# EasyEDA Pro project STM32G303的双FOC电机驱动.eprj, schematic axdr_v1.2 (continued)
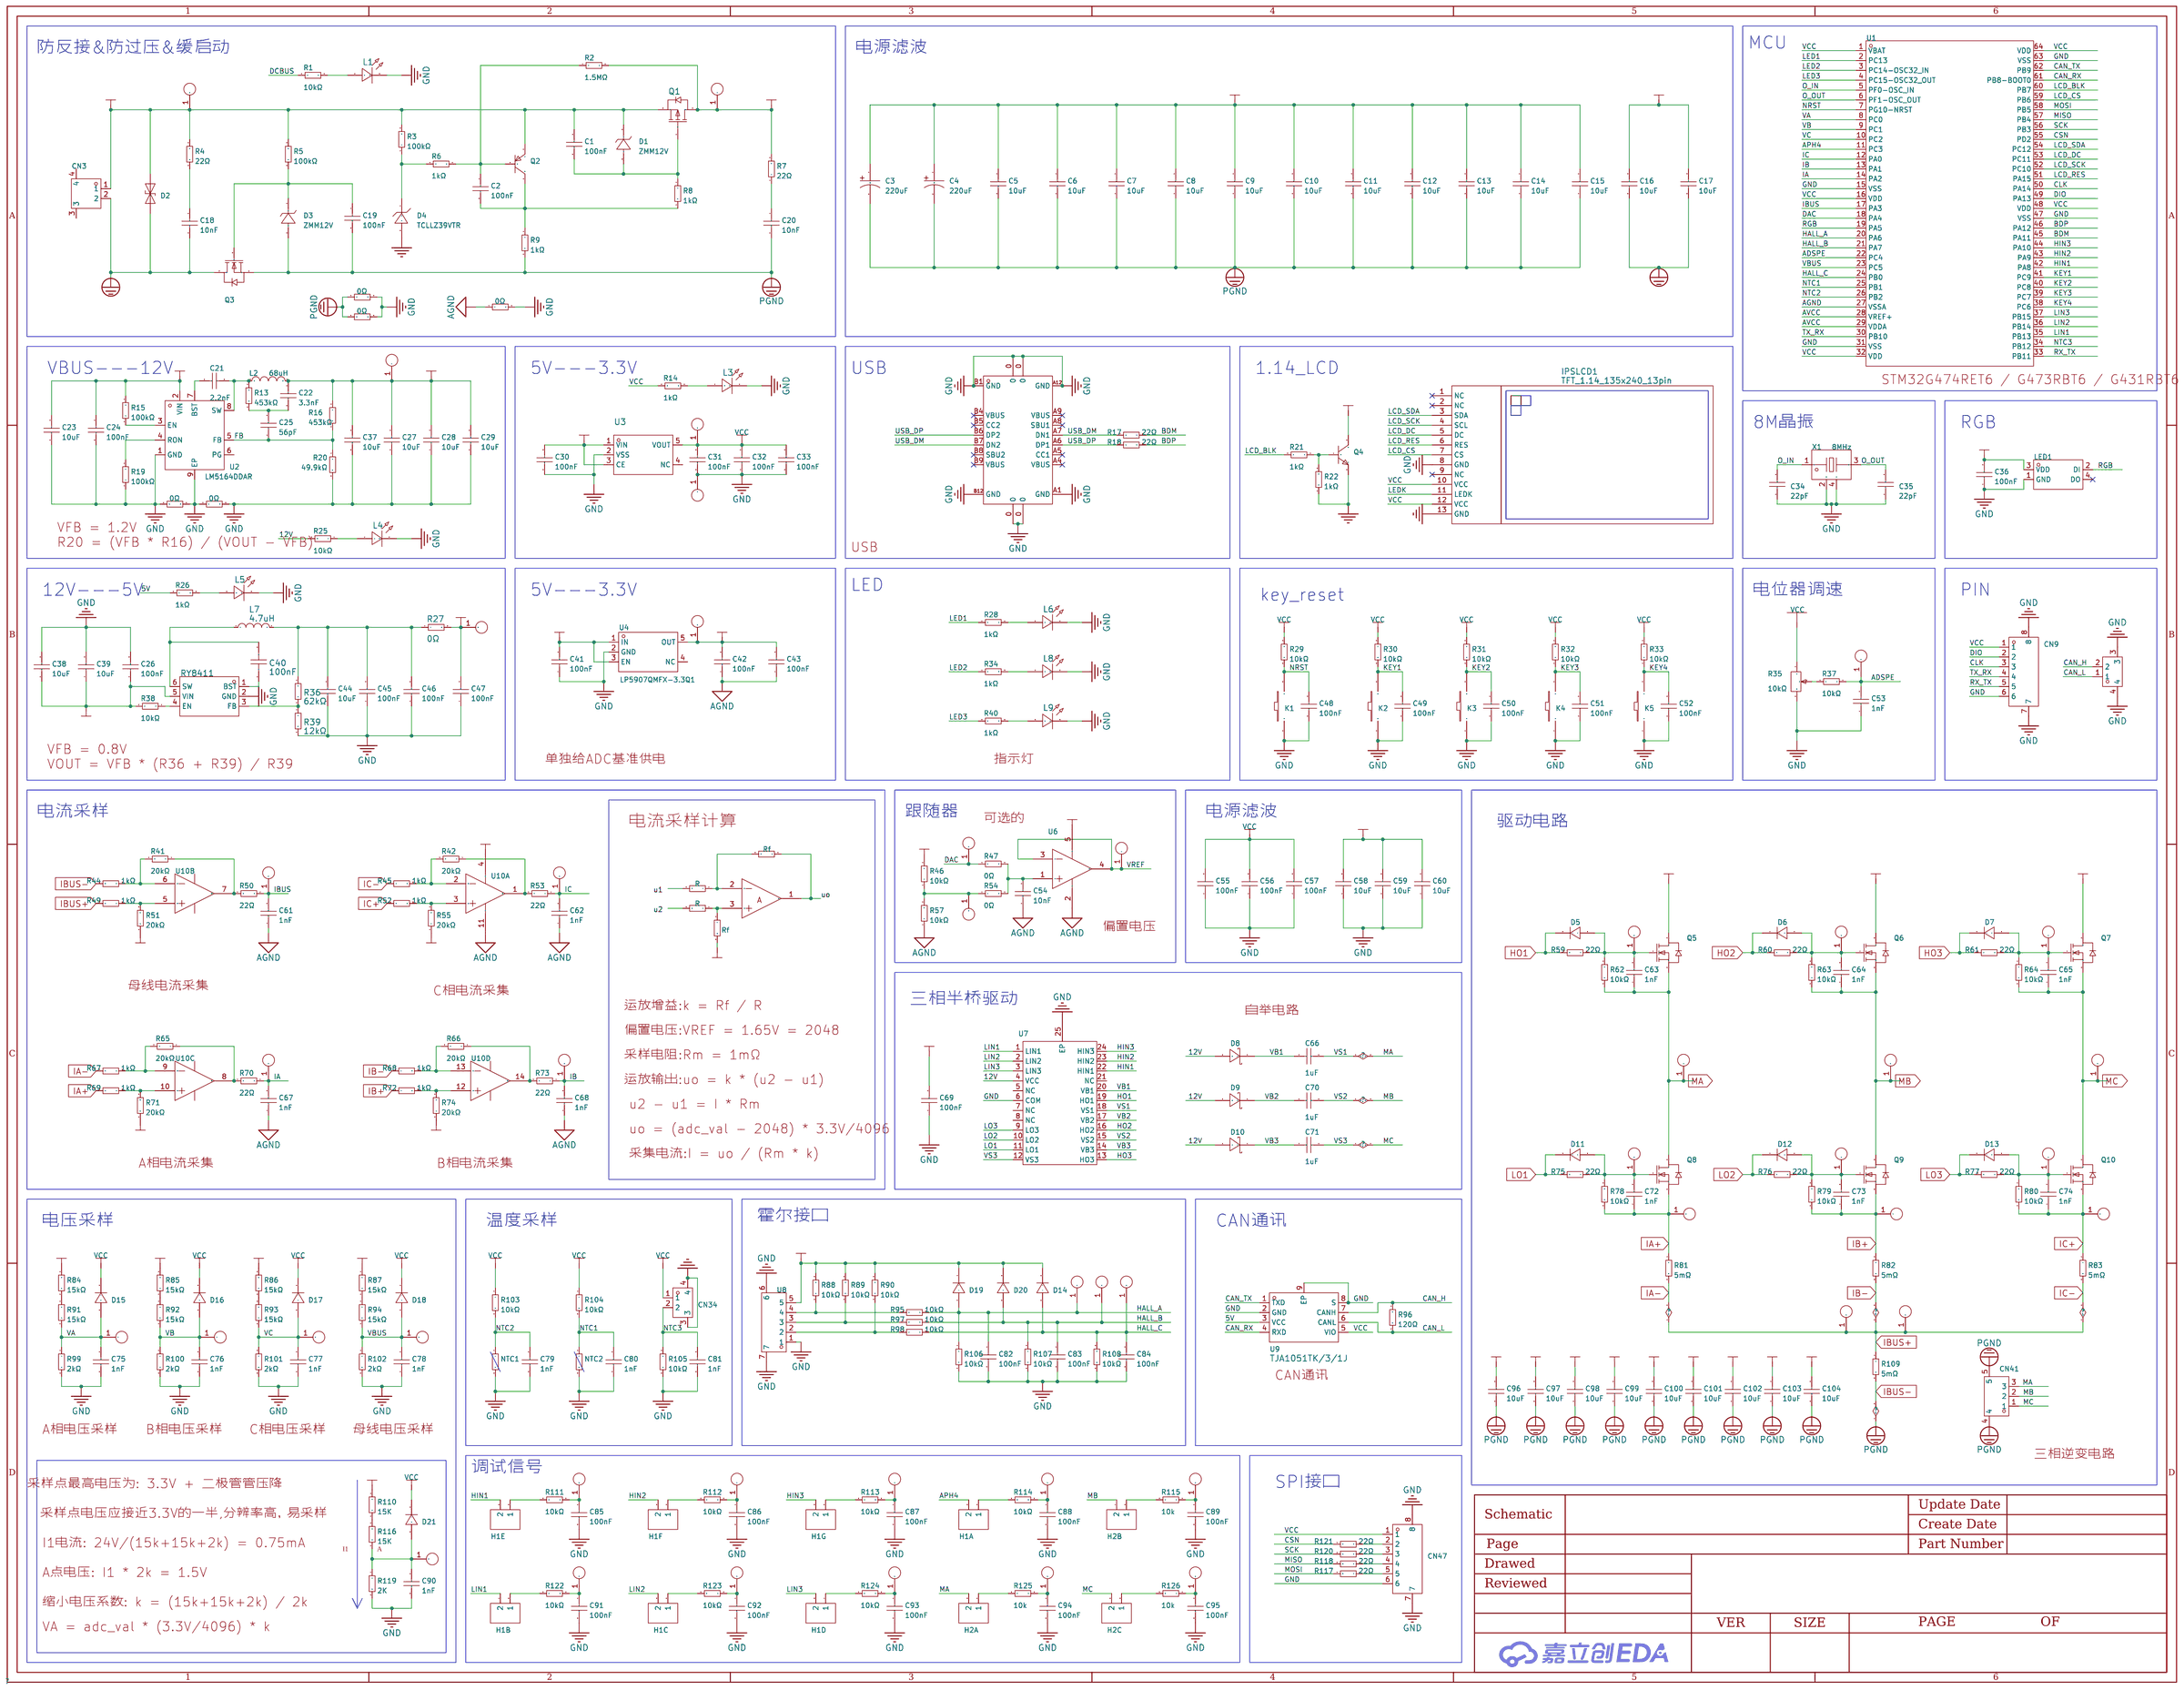
[diagram p0: schematic sheet]
## Nets (continued)
HO2: D6.1(-) R60.2 U7.16(HO2)
HO3: D7.1(-) R61.2 U7.13(HO3)
IA: C67.2 CN20.1 R70.1 U1.14(PA2)
IA+: C72.1 CN28.1 Q8.3(S) R69.1 R78.2 R81.1
IA-: CN35.1 CN36.1 R45.1 R49.1 R67.1 R68.1 R81.2 R82.2 R83.2 R109.1
IB: C68.2 CN21.1 R73.1 U1.13(PA1)
IB+: C73.1 CN29.1 Q9.3(S) R72.1 R79.2 R82.1
IBUS: C61.2 CN14.1 R50.1 U1.17(PA3)
IC: C62.2 CN15.1 R53.1 U1.12(PA0)
IC+: C74.1 CN30.1 Q10.3(S) R52.1 R80.2 R83.1
KEY1: C49.2 K2.2 R30.1 U1.41(PC9)
KEY2: C50.2 K3.2 R31.1 U1.40(PC8)
KEY3: C51.2 K4.2 R32.1 U1.39(PC7)
KEY4: C52.2 K5.2 R33.1 U1.38(PC6)
LCD_BLK: R21.2 U1.60(PB7)
LCD_CS: IPSLCD1.7(CS) U1.59(PB6)
LCD_DC: IPSLCD1.5(DC) U1.53(PC11)
LCD_RES: IPSLCD1.6(RES) U1.51(PA15)
LCD_SCK: IPSLCD1.4(SCL) U1.52(PC10)
LCD_SDA: IPSLCD1.3(SDA) U1.54(PC12)
LED1: R28.2 U1.2(PC13)
LED2: R34.1 U1.3(PC14-OSC32_IN)
LED3: R40.2 U1.4(PC15-OSC32_OUT)
LEDK: IPSLCD1.11(LEDK) Q4.3(C)
LIN1: H1.4(2) U1.35(PB13) U7.1(LIN1)
LIN2: H1.6(2) U1.36(PB14) U7.2(LIN2)
LIN3: H1.8(2) U1.37(PB15) U7.3(LIN3)
LO1: D11.1(-) R75.2 U7.11(LO1)
LO2: D12.1(-) R76.2 U7.10(LO2)
LO3: D13.1(-) R77.2 U7.9(LO3)
MA: C63.1 C66.1 CN22.1 CN41.3 H2.2 Q5.3(S) Q8.2(D) R62.2 R84.1 U7.18(VS1)
MB: C64.1 C70.1 CN23.1 CN41.2 H2.4(2) Q6.3(S) Q9.2(D) R63.2 R85.1 U7.15(VS2)
MC: C65.1 C71.1 CN24.1 CN41.1 H2.6(2) Q7.3(S) Q10.2(D) R64.2 R86.1 U7.12(VS3)
MISO: R118.2 U1.57(PB4)
MOSI: R117.2 U1.58(PB5)
NRST: C48.2 K1.2 R29.1 U1.7(PG10-NRST)
NTC1: C80.2 NTC2.1 R104.2 U1.25(PB1)
NTC2: C79.2 NTC1.1 R103.2 U1.26(PB2)
NTC3: C81.2 CN34.2 R105.1 U1.34(PB12)
O_IN: C34.2 U1.5(PF0-OSC_IN) X1.1
O_OUT: C35.2 U1.6(PF1-OSC_OUT) X1.3
RGB: LED1.2(DI) U1.19(PA5)
RX_TX: CN9.5 U1.33(PB11)
SCK: R120.2 U1.56(PB3)
TX_RX: CN9.4 U1.30(PB10)
USB_DM: R17.1 USBC1.A7(DN1) USBC1.B7(DN2)
USB_DP: R18.1 USBC1.A6(DP1) USBC1.B6(DP2)
VA: C75.2 CN37.1 D15.2(+) R91.2 R99.1 U1.8(PC0)
VB: C76.2 CN38.1 D16.2(+) R92.2 R100.1 U1.9(PC1)
VB1: C66.2 D8.1 U7.20(VB1)
VB2: C70.2 D9.1 U7.17(VB2)
VB3: C71.2 D10.1 U7.14(VB3)
VC: C77.2 CN39.1 D17.2(+) R93.2 R101.1 U1.10(PC2)
VREF: CN13.1 R51.1 R55.1 R58.2 R71.1 R74.1 U6.3(IN-) U6.4(OUT)
$1N7256: C18.1 R4.1
$1N10553: C2.1 Q2.1(B) R2.1 R6.1
$1N11589: C19.1 D3.1(K) Q3.1(G) R5.1
$1N11866: D4.1(C) R3.1 R6.2
$1N12961: C20.1 R7.1
$1N15998: C2.2 Q2.3(C) R8.2 R9.1
$1N55849: C63.2 CN17.1 D5.2(+) Q5.1(G) R59.1 R62.1
$1N56388: C72.2 CN25.1 D11.2(+) Q8.1(G) R75.1 R78.1
$1N57486: C64.2 CN18.1 D6.2(+) Q6.1(G) R60.1 R63.1
$1N57488: C73.2 CN26.1 D12.2(+) Q9.1(G) R76.1 R79.1
$1N58344: C65.2 CN19.1 D7.2(+) Q7.1(G) R61.1 R64.1
$1N58346: C74.2 CN27.1 D13.2(+) Q10.1(G) R77.1 R80.1
$1N74659: R52.2 R55.2 U10.3(+INA)
$1N75153: R42.2 R45.2 U10.2(-INA)
$1N75339: R42.1 R53.2 U10.1(OUTA)
$1N78360: R41.1 R50.2 U10.7(OUTB)
$1N78363: R49.2 R51.2 U10.5(+INB)
$1N78364: R41.2 R44.2 U10.6(-INB)
$1N79721: R66.1 R73.2 U10.14(OUTD)
$1N79723: R72.2 R74.2 U10.12(+IND)
$1N79724: R66.2 R68.2 U10.13(-IND)
$1N80505: R65.1 R70.2 U10.8(OUTC)
$1N80507: R69.2 R71.2 U10.10(+INC)
$1N80508: R65.2 R67.2 U10.9(-INC)
$1N96819: R84.2 R91.1
$1N96824: R85.2 R92.1
$1N96829: R87.2 R94.1
$1N96834: R86.2 R93.1
$1N107842: R88.2 R95.1 U8.4
$1N108105: R89.2 R97.1 U8.3
$1N108370: R90.2 R98.1 U8.2
$1N130103: L9.1 R40.1
$1N130414: L8.1 R34.2
$1N134680: L5.1 R26.1
$1N145652: CN47.5 R117.1
$1N145656: CN47.4 R118.1
$1N145660: CN47.3 R120.1
$1N145664: CN47.2 R121.1
$1N245778: R36.2 R39.1 U5.3(FB)
$1N245779: C40.2 L7.1 U5.6(SW)
$1N245780: C40.1 U5.1(BST)
$1N268846: L3.1 R14.2
$1N269486: L1.1 R1.1
$1N270139: C85.1 CN42.1 R111.1
$1N270143: H1.9(1) R111.2
$1N270253: C91.1 CN49.1 R122.1
$1N270255: H1.3(1) R122.2
$1N270473: C86.1 CN43.1 R112.1
$1N270475: H1.11(1) R112.2
$1N270480: C92.1 CN50.1 R123.1
$1N270482: H1.5(1) R123.2
$1N270701: C87.1 CN44.1 R113.1
$1N270703: H1.13(1) R113.2
$1N270708: C93.1 CN51.1 R124.1
$1N270710: H1.7(1) R124.2
$1N398404: C1.2 D1.2(A) Q1.1(G) R8.1
$1N441583: C88.1 CN45.1 R114.1
$1N441584: H1.1 R114.2
$1N704042: L6.1 R28.1
$1N752227: CN16.1 R46.1 R54.1 R57.2
$1N807322: R35.2 R37.2
$1N846235: R38.1 U5.4(EN)
$1N858763: C54.2 R47.2 R54.2 U6.1(IN+)
$1N920711: Q4.1(B) R21.1 R22.1
$1N958663: C44.1 C45.2 C46.2 L7.2 R27.1 R36.1
$1N1062496: L4.1 R25.1
$1N1062500: R19.1 U2.4(RON)
$1N1062505: C22.2 C25.2 R13.2
$1N1062506: C21.2 L2.1 R13.1 U2.8(SW)
$1N1062507: R15.2 U2.3(EN)
$1N1062508: C21.1 U2.7(BST)
Net-(C89-1): C89.1 CN46.1 R115.1
Net-(C90-2): C90.2 CN48.1 D21.2(+) R116.2 R119.1
Net-(C94-1): C94.1 CN52.1 R125.1
Net-(C95-1): C95.1 CN53.1 R126.1
Net-(H2-1): H2.1 R125.2
Net-(H2-3): H2.3(1) R115.2
Net-(H2-5): H2.5(1) R126.2
Net-(R43-1): R43.1 U11.1(OUTA)
Net-(R43-2): R43.2 R48.1 U11.2(INA-)
Net-(R56-1): R56.1 R58.1 U11.3(INA+)
Net-(R110-2): R110.2 R116.1

Not connected (* = marked no-connect by the designer): CN3 3 4; IPSLCD1 1(NC)* 2(NC)* 9(NC)*; LED1 4(DO)*; R48 2; R56 2; U2 6(PG); U3 4(NC); U4 4(NC); U7 5(NC) 7(NC) 8(NC) 21(NC); USBC1 A4(VBUS)* A5(CC1)* A8(SBU1)* A9(VBUS)* B4(VBUS)* B5(CC2)* B8(SBU2)* B9(VBUS)*

## Notes on the sheet
- 防反接&防过压&缓启动
- 电源滤波
- MCU
- VBUS---12V
- 5V---3.3V
- USB
- 1.14_LCD
- STM32G474RET6 / G473RBT6 / G431RBT6
- 8M晶振
- RGB
- VFB = 1.2V
- R20 = (VFB * R16) / (VOUT - VFB)
- USB
- LED
- 12V---5V
- 5V---3.3V
- key_reset
- 电位器调速
- PIN
- VFB = 0.8V
- 单独给ADC基准供电
- 指示灯
- VOUT = VFB * (R36 + R39) / R39
- 电流采样
- 跟随器
- 可选的
- 电源滤波
- 电流采样计算
- 驱动电路
- u1
- uo
- u2
- 偏置电压
- 母线电流采集
- C相电流采集
- 运放增益:k = Rf / R
- 三相半桥驱动
- 自举电路
- 偏置电压:VREF = 1.65V = 2048
- 采样电阻:Rm = 1mΩ
- 运放输出:uo = k * (u2 - u1)
- u2 - u1 = I * Rm
- uo = (adc_val - 2048) * 3.3V/4096
- 采集电流:I = uo / (Rm * k)
- A相电流采集
- B相电流采集
- 电压采样
- 温度采样
- 霍尔接口
- CAN通讯
- CAN通讯
- A相电压采样
- B相电压采样
- C相电压采样
- 母线电压采样
- 三相逆变电路
- 调试信号
- 采样点最高电压为: 3.3V + 二极管管压降
- SPI接口
- 采样点电压应接近3.3V的一半,分辨率高，易采样
- I1电流: 24V/(15k+15k+2k) = 0.75mA
- I1
- A
- A点电压: I1 * 2k = 1.5V
- 缩小电压系数: k = (15k+15k+2k) / 2k
- VA = adc_val * (3.3V/4096) * k
